# EasyEDA Pro project Iot-Whgm5开发板.eprj, board PCB1
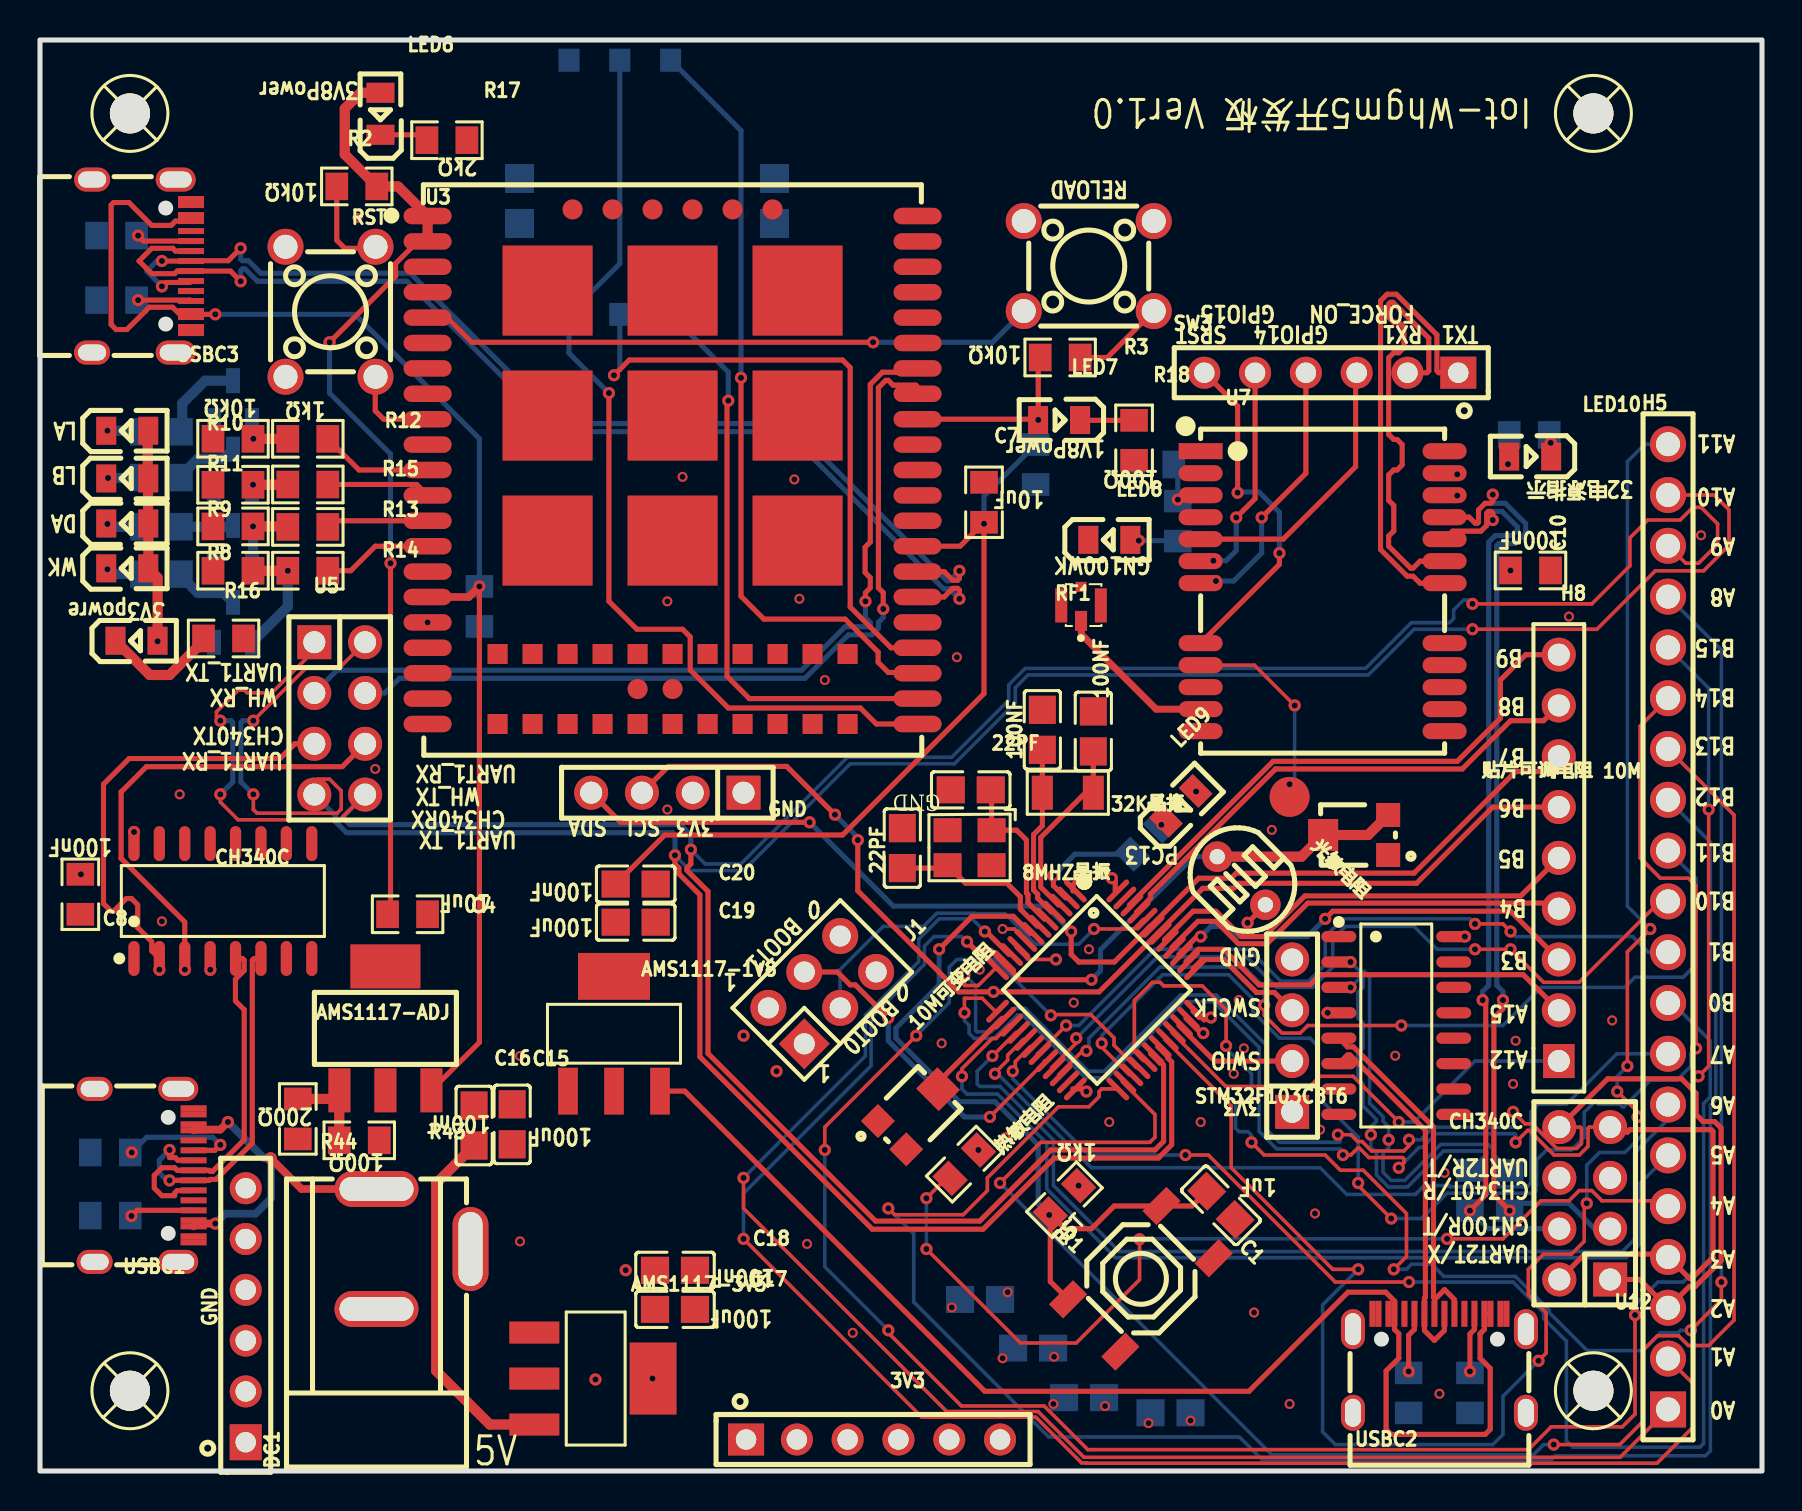
[diagram p2: board, top side]
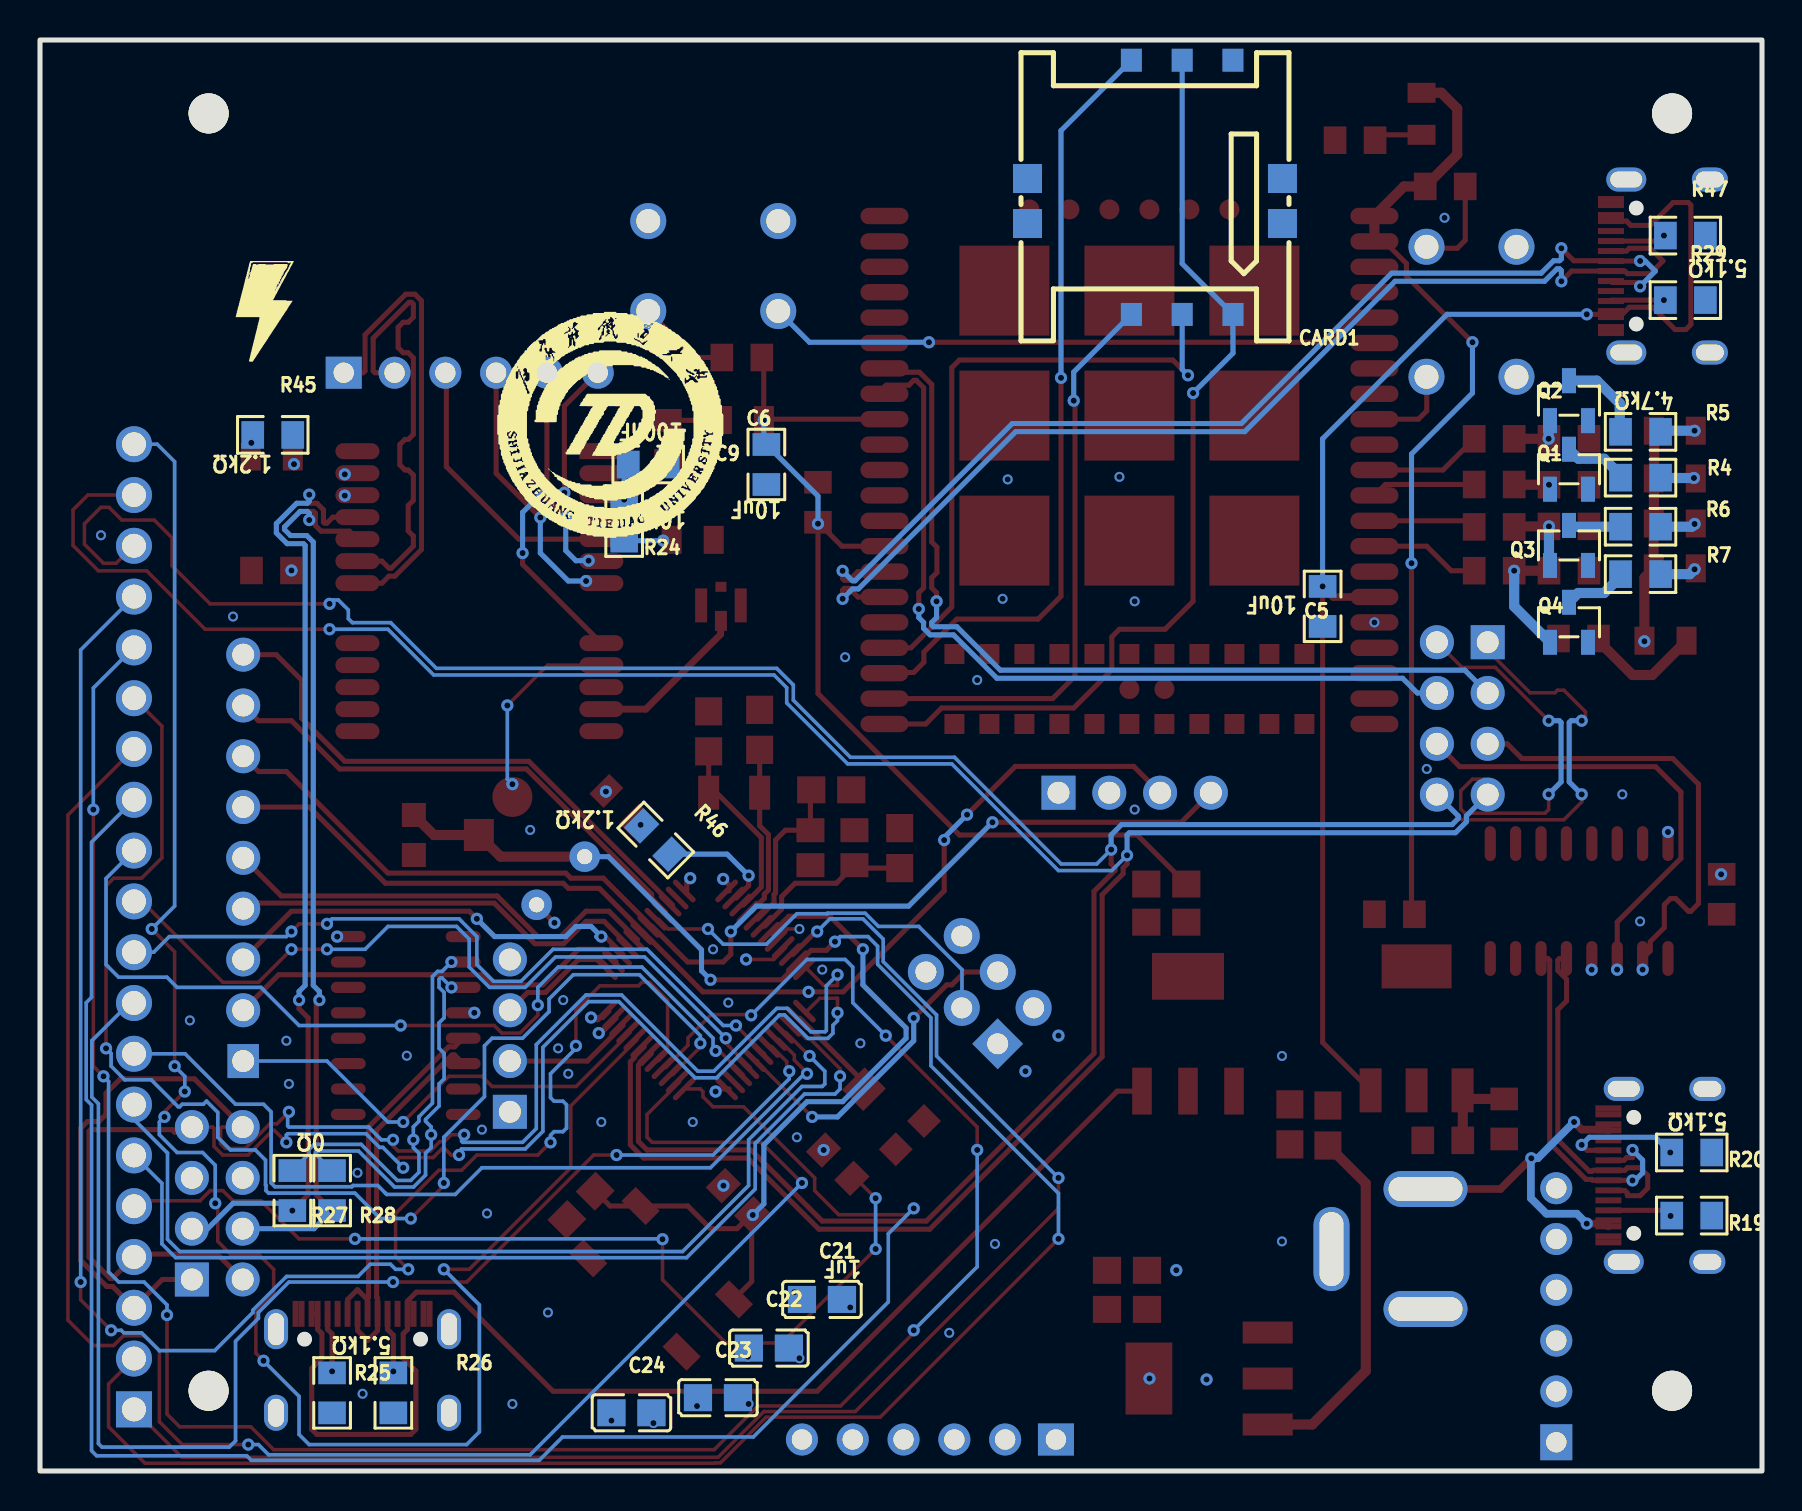
[diagram p3: board, bottom side, seen from below]

Outline 86.11 x 71.55 mm; copper layers: Top Layer, Inner1, Inner2, Bottom Layer. Coordinates in mm from the lower left corner of the outline.
Outline path: rectangle 0,71.55 86.11,0
Stack: Top Layer 0.035mm 外层铜厚1oz / Dielectric1 0.2104mm 7628 RC49% 8.6mil / Inner1 0.0152mm 内层铜厚 / Dielectric2 1.065mm 1.1mm H/HOZ 含铜 / Inner2 0.0152mm 内层铜厚 / Dielectric3 0.2104mm 7628 RC49% 8.6mil / Bottom Layer 0.035mm 外层铜厚1oz

## Design rules (mm)
net UART2_TX: DP10
net UART2_RX: DP10
net UART1_RX: DP8
net I2C1SCL: DP11
net I2C1SDA: DP11
net USBD-: DP3
net USBD+: DP3
net CH340TX: DP5
net CH340RX: DP5
net UART1_TX: DP8
net WH_RX: DP7
net WH_TX: DP7
net GN100_RXD: DP9
net GN100_TXD: DP9
net GN100RX1: DP4
net GN100TX1: DP4
net USBD-1: DP1
net USBD+1: DP1
net $1N7760: DP2
net $1N7771: DP2
net USBDM: DP6
net USBDP: DP6
template: 自定义配置
spacing copperThickness1oz (default): track to track 0, other pairs 0 to 0.3
spacing copperThickness2oz: track to track 0.203, other pairs 0.152 to 0.3
track width copperThickness1oz (default): min 0.127, default 0.254, max 2.54
track width copperThickness2oz: min 0.203, default 0.254, max 2.54
differential pair differentialPair (default): width min 0.127, default 0.254, max 2.54; gap min 0.152, default 0.152
via viaSize (default): diameter min 0.5, default 0.61, max 10; hole min 0.3, default 0.305, max 6.299
net GND uses copperRegion1

## Placement (name value [footprint] x y rotation side)
3V3  -  [HDR-TH_6P-P2.54-V-F]  41.66 1.57 0 top
8MHZ晶振  8MHz  [OSC-SMD_4P-L3.2-W2.5-BL]  46.48 31.17 180 top
10M可变电阻  10kΩ  [RES-ADJ-SMD_3P-L3.0-W3.8-P1.75-BR]  43.76 17.94 225 top
22PF  -  [C0805]  46.54 34.06 0 top
22PF#2  -  [C0805]  43.12 31.15 270 top
32K晶振  32.768kHz  [CRYSTAL-SMD_L3.2-W1.5-1]  51.4 33.91 0 top
100NF  -  [C0805]  50.12 37.06 90 top
100NF#2  -  [C0805]  52.67 36.98 270 top
AMS1117-1V8  AMS1117-1.8  [SOT-223-3_L6.7-W3.7-P2.30-LS7.0-BR]  28.7 21.86 270 top
AMS1117-3V3  AMS1117-3.3  [SOT-223-3_L6.5-W3.4-P2.30-LS7.0-BR]  27.69 4.62 180 top
AMS1117-ADJ  AMS1117-ADJ  [SOT-223_L6.7-W3.5-P2.30-BR]  17.27 22.13 270 top
C1  1uF  [C0805]  59.05 13.28 135 top
C4  10uF  [D0805]  18.38 27.84 180 top
C5  10uF  [D0805]  21.97 43.23 90 bottom
C6  10uF  [D0805]  49.78 50.33 270 bottom
C7  10uF  [D0805]  47.2 48.44 90 top
C8  100nF  [D0805]  2.02 28.84 90 top
C9  100nF  [D0805]  55.69 50.33 0 bottom
C10  100nF  [D0805]  74.53 45.03 180 top
C15  100uF  [C0805]  23.61 17.33 90 top
C16  100nF  [C0805]  21.71 17.27 90 top
C17  100uF  [C0805]  31.75 8.08 0 top
C18  100nF  [C0805]  31.75 10.04 0 top
C19  100uF  [C0805]  29.79 27.44 0 top
C20  100nF  [C0805]  29.79 29.35 0 top
C21  1uF  [C0805]  47.01 8.58 180 bottom
C22  1uF  [C0805]  49.66 6.15 180 bottom
C23  1uF  [C0805]  52.21 3.67 180 bottom
C24  1uF  [C0805]  56.53 2.91 180 bottom
CARD1  SIM-213  [SIM-SMD_SIM-213_C2836124]  30.35 64.19 0 bottom
CH340C  -  [SOP-16_L10.0-W3.9-P1.27-LS6.0-BL]  9.14 28.5 0 top
CH340C#2  -  [SOP-16_L10.0-W3.9-P1.27-LS6.0-BL]  67.82 22.28 270 top
DC1  DC-005-2.5A-2.0  [CONN-TH_DC-005-2.5A-2.0]  19.18 11.1 90 top
GND  -  [HDR-TH_4P-P2.54-V-F]  31.37 33.91 180 top
GND#2  -  [HDR-TH_6P-P2.54-V-F]  10.29 7.79 90 top
H1  PZ254V-11-04P  [HDR-TH_4P-P2.54-V-M]  62.61 21.77 90 top
H3  -  [HDR-TH_6P-P2.54-V-F]  64.57 54.91 180 top
H5  -  [HDR-TH_20P-P2.54-V-F]  81.41 27.21 90 top
H8  -  [HDR-TH_9P-P2.54-V-F-1]  75.95 30.66 90 top
J1  2.54-2*3P针  [HDR-TH_6P-P2.54-V-M-R2-C3-S2.54-1]  39.12 24.05 45 top
LED1  NCD0805R1  [LED0805-R-RD]  4.36 49.63 0 top
LED2  NCD0805R1  [LED0805-R-RD]  4.36 52.01 0 top
LED3  NCD0805R1  [LED0805-R-RD]  4.36 47.38 0 top
LED4  NCD0805R1  [LED0805-R-RD]  4.36 45.13 0 top
LED5  NCD0805R1  [LED0805-R-RD]  4.83 41.51 0 top
LED6  NCD0805R1  [LED0805-R-RD]  17.02 67.86 90 top
LED7  NCD0805R1  [LED0805-R-RD]  50.96 52.55 180 top
LED8  NCD0805R1  [LED0805-R-RD]  53.47 46.56 0 top
LED9  NCD0805R1  [LED0805-R-RD]  57.04 33.26 45 top
LED10  NCD0805R1  [LED0805-R-RD]  74.51 50.72 180 top
NOREF  -  [Pad_e6064]  62.48 33.71 0 top
Q1  SS8050  [SOT-23-3_L2.9-W1.3-P1.90-LS2.4-BR]  9.65 50.09 270 bottom
Q2  SS8050  [SOT-23-3_L2.9-W1.3-P1.90-LS2.4-BR]  9.65 53.52 270 bottom
Q3  SS8050  [SOT-23-3_L2.9-W1.3-P1.90-LS2.4-BR]  9.65 46.28 270 bottom
Q4  SS8050  [SOT-23-3_L2.9-W1.3-P1.90-LS2.4-BR]  9.65 42.44 270 bottom
R1  1kΩ  [R0805]  51.23 13.56 225 top
R2  10kΩ  [R0805]  15.84 64.23 180 top
R3  10kΩ  [R0805]  51.01 55.68 0 top
R4  4.7kΩ  [R0805]  6.07 49.67 180 bottom
R5  4.7kΩ  [R0805]  6.07 51.96 180 bottom
R6  4.7kΩ  [R0805]  6.07 47.22 180 bottom
R7  4.7kΩ  [R0805]  6.07 44.84 180 bottom
R8  10kΩ  [R0805]  9.65 45.02 0 top
R9  10kΩ  [R0805]  9.65 47.23 0 top
R10  10kΩ  [R0805]  9.65 51.61 0 top
R11  10kΩ  [R0805]  9.65 49.31 0 top
R12  1kΩ  [R0805]  13.39 51.61 0 top
R13  1kΩ  [R0805]  13.39 47.21 0 top
R14  1kΩ  [R0805]  13.39 45.02 0 top
R15  1kΩ  [R0805]  13.39 49.33 0 top
R16  1.2kΩ  [R0805]  9.18 41.63 180 top
R17  2kΩ  [R0805]  20.35 66.54 180 top
R18  100Ω  [R0805]  54.71 51.54 90 top
R19  5.1kΩ  [R0805]  3.51 12.77 0 bottom
R20  5.1kΩ  [R0805]  3.51 15.93 180 bottom
R24  10kΩ  [R0805]  56.9 47.5 270 bottom
R25  5.1kΩ  [R0805]  71.5 3.91 90 bottom
R26  5.1kΩ  [R0805]  68.44 3.91 270 bottom
R27  0Ω  [R0805]  73.49 14.02 90 bottom
R28  0Ω  [R0805]  71.5 14.02 270 bottom
R29  5.1kΩ  [R0805]  3.83 58.55 0 bottom
R43  100Ω  [R0805]  15.96 16.53 0 top
R44  200Ω  [R0805]  12.89 17.6 90 top
R45  1.2kΩ  [R0805]  74.47 51.81 180 bottom
R46  1.2kΩ  [R0805]  55.31 31.55 225 bottom
R47  5.1kΩ  [R0805]  3.83 61.77 180 bottom
RF1  IPEX-4  [IPEX-SMD_4P-L1.8-W1.7-LS2.0]  52.06 43.36 0 top
RST  -  [SW-SMD_4P-L5.1-W5.1-P3.70-LS6.5-TL-2]  55.05 9.61 225 top
RST#2  -  [SW-TH_4P-L6.0-W6.0-P4.50-LS6.5]  14.53 57.96 270 top
STM32F103C8T6  STM32F103C8T6  [LQFP-48_L7.0-W7.0-P0.50-LS9.0-BL]  52.83 24.05 225 top
SW3  TS665CJ  [SW-TH_4P-L6.0-W6.0-P4.50-LS6.5]  52.44 60.25 180 top
TP8  -  [M2螺丝]  4.5 67.88 0 top
TP9  -  [M2螺丝]  4.5 4.01 0 top
TP10  -  [M2螺丝]  77.68 4.01 0 top
TP11  -  [M2螺丝]  77.68 67.88 0 top
U3  WH-GM5  [LCC-LGA-81_L28.1-W24.5-P1.27-TL]  31.63 50.22 0 top
U5  PZ2.54-2*4  [HDR-TH_8P-P2.54-V-M-R2-C4-S2.54]  14.99 37.63 270 top
U7  WH-GN100  [GPSM-SMD_WH-GN100]  64.13 43.99 0 top
U12  PZ2.54-2*4  [HDR-TH_8P-P2.54-V-M-R2-C4-S2.54]  77.24 13.39 90 top
USBC1  TYPE-C-31-M-12  [USB-C_SMD-TYPE-C-31-M-12]  5.21 14.78 270 top
USBC2  TYPE-C-31-M-12  [USB-C_SMD-TYPE-C-31-M-12]  69.98 5.38 0 top
USBC3  TYPE-C-31-M-12  [USB-C_SMD-TYPE-C-31-M-12]  5.08 60.25 270 top
光敏电阻  光敏电阻  [RES-TH_L5.1-W4.3-P3.40-D0.5]  60.07 29.51 225 top
热敏电阻  10k 热敏电阻  [R0805]  46.22 15.34 225 top
贴片可调电阻 10M  10kΩ  [RES-ADJ-SMD_3P-L3.0-W3.8-P1.75-BR]  65.79 31.8 0 top

## Footprints (pads in the part's own frame, mm; a bottom-side part is the same pattern mirrored in y, then rotated)
C0805
  rect 1.41x1.35 smd: 1(-1,0) 2(1,0)
CONN-TH_DC-005-2.5A-2.0
  oval 1.8x4.2 hole 1.2x3.7: 1(2.999,2.35) 2(-2.999,2.35)
  oval 4.2x1.8 hole 3.7x1.2: 3(0,-2.35)
CRYSTAL-SMD_L3.2-W1.5-1
  rect 1.05x1.7 smd: 1(-1.275,0) 2(1.275,0)
D0805
  rect 1.133x1.377 smd: 1(-1,0) 2(1,0)
GPSM-SMD_WH-GN100
  rect 2.2x0.8 smd: 1(-6.1,7)
  oval 2.2x0.8 smd: 2(-6.1,5.9) 3(-6.1,4.8) 4(-6.1,3.7) 5(-6.1,2.6) 6(-6.1,1.5) 7(-6.1,0.4) 8(-6.1,-2.6) 9(-6.1,-3.7) 10(-6.1,-4.8) 11(-6.1,-5.9) 12(-6.1,-7) 13(6.1,-7) 14(6.1,-5.9) 15(6.1,-4.8) 16(6.1,-3.7) 17(6.1,-2.6) 18(6.1,0.4) 19(6.1,1.5) 20(6.1,2.6) 21(6.1,3.7) 22(6.1,4.8) 23(6.1,5.9) 24(6.1,7)
HDR-TH_4P-P2.54-V-F
  rect 1.7x1.7 hole 1.1: 1(-3.81,0)
  round 1.7 hole 1.1: 2(-1.27,0) 3(1.27,0) 4(3.81,0)
HDR-TH_4P-P2.54-V-M
  rect 1.7x1.7 hole 1.1: 1(-3.81,0)
  round 1.7 hole 1.1: 2(-1.27,0) 3(1.27,0) 4(3.81,0)
HDR-TH_6P-P2.54-V-F
  rect 1.8x1.6 hole 1.02: 1(-6.35,0)
  round 1.6 hole 1.02: 2(-3.81,0) 3(-1.27,0) 4(1.27,0) 5(3.81,0) 6(6.35,0)
HDR-TH_6P-P2.54-V-M-R2-C3-S2.54-1
  rect 1.8x1.8 hole 1.05: 1(-2.54,-1.27)
  round 1.8 hole 1.05: 2(-2.54,1.27) 3(0,-1.27) 4(0,1.27) 5(2.54,-1.27) 6(2.54,1.27)
HDR-TH_8P-P2.54-V-M-R2-C4-S2.54
  rect 1.7x1.7 hole 1.1: 1(-3.81,-1.27)
  round 1.7 hole 1.1: 2(-3.81,1.27) 3(-1.27,-1.27) 4(-1.27,1.27) 5(1.27,-1.27) 6(1.27,1.27) 7(3.81,-1.27) 8(3.81,1.27)
HDR-TH_9P-P2.54-V-F-1
  rect 1.7x1.575 hole 1.1: 1(-10.16,0)
  round 1.7 hole 1.1: 2(-7.62,0) 3(-5.08,0) 4(-2.54,0) 5(0,0) 6(2.54,0) 7(5.08,0) 8(7.62,0) 9(10.16,0)
HDR-TH_20P-P2.54-V-F
  rect 1.8x1.8 hole 1.2: 1(-24.13,0)
  round 1.8 hole 1.2: 2(-21.59,0) 3(-19.05,0) 4(-16.51,0) 5(-13.97,0) 6(-11.43,0) 7(-8.89,0) 8(-6.35,0) 9(-3.81,0) 10(-1.27,0) 11(1.27,0) 12(3.81,0) 13(6.35,0) 14(8.89,0) 15(11.43,0) 16(13.97,0) 17(16.51,0) 18(19.05,0) 19(21.59,0) 20(24.13,0)
IPEX-SMD_4P-L1.8-W1.7-LS2.0
  rect 0.6x1 smd: 1(0.001,-0.852)
  rect 0.6x1.7 smd: 2(0.99,-0.077) 4(-0.99,-0.077)
  rect 0.55x0.5 smd: 3(0.001,0.852)
LCC-LGA-81_L28.1-W24.5-P1.27-TL
  oval 2.4x0.82 smd: 1(-12.25,12.535) 2(-12.25,11.265) 3(-12.25,9.995) 4(-12.25,8.725) 5(-12.25,7.455) 6(-12.25,6.185) 7(-12.25,4.915) 8(-12.25,3.645) 9(-12.25,2.375) 10(-12.25,1.105) 11(-12.25,-0.165) 12(-12.25,-1.435) 13(-12.25,-2.705) 14(-12.25,-3.975) 15(-12.25,-5.245) 16(-12.25,-6.515) 17(-12.25,-7.785) 18(-12.25,-9.055) 19(-12.25,-10.325) 20(-12.25,-11.595) 21(-12.25,-12.865) 22(12.25,-12.865) 23(12.25,-11.595) 24(12.25,-10.325) 25(12.25,-9.055) 26(12.25,-7.785) 27(12.25,-6.515) 28(12.25,-5.245) 29(12.25,-3.975) 30(12.25,-2.705) 31(12.25,-1.435) 32(12.25,-0.165) 33(12.25,1.105) 34(12.25,2.375) 35(12.25,3.645) 36(12.25,4.915) 37(12.25,6.185) 38(12.25,7.455) 39(12.25,8.725) 40(12.25,9.995) 41(12.25,11.265) 42(12.25,12.535)
  rect 1x1 smd: 43(-8.75,-12.865) 44(-7,-12.865) 45(-5.25,-12.865) 46(-3.5,-12.865) 47(-1.75,-12.865) 48(0,-12.865) 49(1.75,-12.865) 50(3.5,-12.865) 51(5.25,-12.865) 52(7,-12.865) 53(8.75,-12.865) 54(-8.75,-9.365) 66(-7,-9.365) 67(-5.25,-9.365) 68(-3.5,-9.365) 69(-1.75,-9.365) 70(0,-9.365) 71(1.75,-9.365) 72(3.5,-9.365) 73(5.25,-9.365) 74(7,-9.365) 75(8.75,-9.365)
  rect 4.5x4.5 smd: 55(-6.25,8.805) 56(0,8.805) 57(6.25,8.805) 58(6.25,2.555) 59(0,2.555) 60(-6.25,2.555) 61(-6.25,-3.695) 62(0,-3.695) 63(6.25,-3.695)
  round 1 smd: 64(-1.75,-11.115) 65(0,-11.115) 76(-5,12.865) 77(-3,12.865) 78(-1,12.865) 79(1,12.865) 80(3,12.865) 81(5,12.865)
LED0805-R-RD
  rect 1x1.399 smd: 1(1.05,0) 2(-1.05,0)
LQFP-48_L7.0-W7.0-P0.50-LS9.0-BL
  oval 0.27x1.5 smd: 1(-2.75,-4.25) 2(-2.25,-4.25) 3(-1.75,-4.25) 4(-1.25,-4.25) 5(-0.75,-4.25) 6(-0.25,-4.25) 7(0.25,-4.25) 8(0.75,-4.25) 9(1.25,-4.25) 10(1.75,-4.25) 11(2.25,-4.25) 12(2.75,-4.25) 25(2.75,4.25) 26(2.25,4.25) 27(1.75,4.25) 28(1.25,4.25) 29(0.75,4.25) 30(0.25,4.25) 31(-0.25,4.25) 32(-0.75,4.25) 33(-1.25,4.25) 34(-1.75,4.25) 35(-2.25,4.25) 36(-2.75,4.25)
  oval 1.5x0.27 smd: 13(4.25,-2.75) 14(4.25,-2.25) 15(4.25,-1.75) 16(4.25,-1.25) 17(4.25,-0.75) 18(4.25,-0.25) 19(4.25,0.25) 20(4.25,0.75) 21(4.25,1.25) 22(4.25,1.75) 23(4.25,2.25) 24(4.25,2.75) 37(-4.25,2.75) 38(-4.25,2.25) 39(-4.25,1.75) 40(-4.25,1.25) 41(-4.25,0.75) 42(-4.25,0.25) 43(-4.25,-0.25) 44(-4.25,-0.75) 45(-4.25,-1.25) 46(-4.25,-1.75) 47(-4.25,-2.25) 48(-4.25,-2.75)
M2螺丝
  round 2 hole 2: 1(0,0)
OSC-SMD_4P-L3.2-W2.5-BL
  rect 1.4x1.2 smd: 1(-1.1,-0.875) 2(1.1,-0.875) 3(1.1,0.875) 4(-1.1,0.875)
Pad_e6064
  round 2 smd: 1(0,0)
R0805
  rect 1.133x1.377 smd: 1(-1,0) 2(1,0)
RES-ADJ-SMD_3P-L3.0-W3.8-P1.75-BR
  rect 1.2x1.2 smd: 1(1.625,-1) 3(1.625,1)
  rect 1.5x1.6 smd: 2(-1.625,0)
RES-TH_L5.1-W4.3-P3.40-D0.5
  round 1.524 hole 0.762: 1(0,1.7) 2(0,-1.7)
SIM-SMD_SIM-213_C2836124
  rect 1.05x1.15 smd: 1(-3.9,6.355) 2(-1.36,6.355) 3(1.18,6.355) 5(-3.9,-6.355) 6(-1.36,-6.355) 7(1.18,-6.355)
  rect 1.45x1.45 smd: 8(-6.375,-0.44) 9(6.375,-0.44) 10(6.375,1.81) 11(-6.375,1.81)
SOP-16_L10.0-W3.9-P1.27-LS6.0-BL
  oval 0.56x1.745 smd: 1(-4.445,-2.873) 2(-3.175,-2.873) 3(-1.905,-2.873) 4(-0.635,-2.873) 5(0.635,-2.873) 6(1.905,-2.873) 7(3.175,-2.873) 8(4.445,-2.873) 9(4.445,2.873) 10(3.175,2.873) 11(1.905,2.873) 12(0.635,2.873) 13(-0.635,2.873) 14(-1.905,2.873) 15(-3.175,2.873) 16(-4.445,2.873)
SOT-23-3_L2.9-W1.3-P1.90-LS2.4-BR
  rect 1.25x0.7 smd: 1(1,-0.95) 2(1,0.95) 3(-1,0)
SOT-223-3_L6.5-W3.4-P2.30-LS7.0-BR
  rect 2.5x1.1 smd: 1(2.97,-2.3) 2(2.97,0) 3(2.97,2.3)
  rect 2.34x3.6 smd: 4(-2.97,0)
SOT-223-3_L6.7-W3.7-P2.30-LS7.0-BR
  rect 2.34x0.98 smd: 1(2.87,-2.3) 2(2.87,0) 3(2.87,2.3)
  rect 2.34x3.6 smd: 4(-2.87,0)
SOT-223_L6.7-W3.5-P2.30-BR
  rect 2.2x1.1 smd: 1(3.099,-2.3) 2(3.099,0) 3(3.099,2.3)
  rect 2.2x3.5 smd: 4(-3.099,0)
SW-SMD_4P-L5.1-W5.1-P3.70-LS6.5-TL-2
  rect 1.7x1 smd: 1(-3.3,1.85) 2(3.3,1.85) 3(-3.3,-1.85) 4(3.3,-1.85)
SW-TH_4P-L6.0-W6.0-P4.50-LS6.5
  round 1.8 hole 1.2: 1(-3.25,2.25) 2(3.25,2.25) 3(-3.25,-2.25) 4(3.25,-2.25)
USB-C_SMD-TYPE-C-31-M-12
  oval 1.2x2 hole 0.8x1.6: 0(-4.325,1.706) 1(4.325,1.706)
  oval 1.2x1.8 hole 0.8x1.4: 2(4.325,-2.474) 3(-4.325,-2.474)
  rect 0.3x1.3 smd: A1(-3.35,2.474) A4(-2.55,2.474) A5(-1.25,2.474) A6(-0.25,2.474) A7(0.25,2.474) A8(1.25,2.474) A9(2.55,2.474) A12(3.35,2.474) B1(3.05,2.474) B4(2.25,2.474) B5(1.75,2.474) B6(0.75,2.474) B7(-0.75,2.474) B8(-1.75,2.474) B9(-2.25,2.474) B12(-3.05,2.474)

## Nets
1V8: AMS1117-1V8.2 AMS1117-1V8.4 C6.1 C7.1 C19.1 C20.1 LED7.1 R3.1 U3.29 U3.34
3V3: 3V3.1 3V3.2 3V3.3 3V3.4 3V3.5 3V3.6 AMS1117-3V3.2 AMS1117-3V3.4 C8.2 C10.2 C17.1 C18.1 C21.2 C22.2 C23.2 C24.2 CH340C.4 CH340C.16 CH340C#2.4 CH340C#2.16 GND.2 H1.1 J1.1 J1.2 LED1.1 LED2.1 LED3.1 LED4.1 LED5.1 LED9.1 LED10.1 R1.1 STM32F103C8T6.1 STM32F103C8T6.9 STM32F103C8T6.24 STM32F103C8T6.36 STM32F103C8T6.48 U7.22 U7.23 光敏电阻.1 热敏电阻.1
3V8: AMS1117-ADJ.2 AMS1117-ADJ.4 C4.2 LED6.1 R2.1 R43.2 U3.1 U3.2
5V0: AMS1117-1V8.3 AMS1117-3V3.3 AMS1117-ADJ.3 C5.2 C15.1 C16.1 DC1.1 U3.16 USBC1.A4 USBC1.A9 USBC1.B4 USBC1.B9 USBC2.A4 USBC2.A9 USBC2.B4 USBC2.B9 USBC3.A4 USBC3.A9 USBC3.B4 USBC3.B9
GND: 8MHZ晶振.2 8MHZ晶振.4 10M可变电阻.1 22PF.1 22PF#2.1 100NF.2 100NF#2.1 AMS1117-1V8.1 AMS1117-3V3.1 C1.1 C4.1 C5.1 C6.2 C7.2 C8.1 C9.1 C10.1 C15.2 C16.2 C17.2 C18.2 C19.2 C20.2 C21.1 C22.1 C23.1 C24.1 CARD1.5 CARD1.8 CARD1.9 CARD1.10 CARD1.11 CH340C.1 CH340C#2.1 DC1.2 DC1.3 GND.1 GND#2.1 GND#2.2 GND#2.3 GND#2.4 GND#2.5 GND#2.6 H1.4 J1.5 J1.6 LED8.2 Q1.2 Q2.2 Q3.2 Q4.2 R8.1 R9.1 R10.1 R11.1 R16.1 R17.1 R18.1 R19.1 R20.2 R25.1 R26.2 R29.1 R44.1 R45.2 R47.2 RF1.2 RF1.3 RF1.4 RST.1 RST.2 RST#2.3 RST#2.4 STM32F103C8T6.8 STM32F103C8T6.23 STM32F103C8T6.35 STM32F103C8T6.47 SW3.3 SW3.4 TP8.1 TP9.1 TP10.1 TP11.1 U3.3 U3.4 U3.17 U3.39 U3.40 U3.42 U7.10 U7.12 U7.13 U7.24 USBC1.0 USBC1.1 USBC1.2 USBC1.3 USBC1.A1 USBC1.A12 USBC1.B1 USBC1.B12 USBC2.0 USBC2.1 USBC2.2 USBC2.3 USBC2.A1 USBC2.A12 USBC2.B1 USBC2.B12 USBC3.0 USBC3.1 USBC3.2 USBC3.3 USBC3.A1 USBC3.A12 USBC3.B1 USBC3.B12 贴片可调电阻 10M.1
VCCRF: NOREF.1 U7.9
ADC_IN1: H5.2 STM32F103C8T6.11 光敏电阻.2 贴片可调电阻 10M.2 贴片可调电阻 10M.3
ADC_IN4: 10M可变电阻.2 10M可变电阻.3 H5.5 STM32F103C8T6.14 热敏电阻.2
BOOT0: J1.3 STM32F103C8T6.44
BOOT1: J1.4 STM32F103C8T6.20
CH340RX: CH340C.3 U5.6
CH340RX1: CH340C#2.3 U12.6
CH340TX: CH340C.2 U5.5
CH340TX1: CH340C#2.2 U12.5
DATA: R13.2 U3.13
DRX: U3.32
DTX: U3.33
FORCE_ON: H3.3 U7.5
GN100_RXD: R27.1 U7.21 U12.3
GN100_TXD: R28.2 U7.20 U12.4
GN100RST: H3.6 U7.8
GN100RX1: H3.2 U7.19
GN100TX1: H3.1 U7.18
GPIO14: H3.4 U7.7
GPIO15: H3.5 U7.6
GPRS: U3.10
I2C1SCL: GND.3 H8.6 STM32F103C8T6.42
I2C1SDA: GND.4 H8.7 STM32F103C8T6.43
IPPS: C9.2 R24.1 U7.3
KEYIN: U3.31
LINKA: R12.2 U3.11
LINKB: R15.2 U3.12
OSC32_IN: 32K晶振.2 100NF#2.2 STM32F103C8T6.3
OSC32_OUT: 32K晶振.1 100NF.1 STM32F103C8T6.4
OSC_IN: 8MHZ晶振.1 22PF.2 STM32F103C8T6.5
OSC_OUT: 8MHZ晶振.3 22PF#2.2 STM32F103C8T6.6
PA0: H5.1 STM32F103C8T6.10
PA5: H5.6 STM32F103C8T6.15
PA6: H5.7 STM32F103C8T6.16
PA7: H5.8 STM32F103C8T6.17
PA8: H5.17 STM32F103C8T6.29
PA11: H5.20 STM32F103C8T6.32
PA12: H8.1 STM32F103C8T6.33
PA15: H8.2 STM32F103C8T6.38
PB0: H5.9 STM32F103C8T6.18
PB1: H5.10 STM32F103C8T6.19
PB3: H8.3 STM32F103C8T6.39
PB4: H8.4 STM32F103C8T6.40
PB5: H8.5 STM32F103C8T6.41
PB8: H8.8 STM32F103C8T6.45
PB9: H8.9 STM32F103C8T6.46
PB10: H5.11 STM32F103C8T6.21
PB11: H5.12 STM32F103C8T6.22
PB12: H5.13 STM32F103C8T6.25
PB13: H5.14 STM32F103C8T6.26
PB14: H5.15 STM32F103C8T6.27
PB15: H5.16 STM32F103C8T6.28
PC13: R46.2 STM32F103C8T6.2
RELOAD: SW3.2 U3.5
RF_IN: RF1.1 U7.11
RST: C1.2 R1.2 RST.3 RST.4 STM32F103C8T6.7
SCLK: CARD1.3 U3.23
SDAT: CARD1.7 U3.24
SRST: CARD1.2 U3.25
SWCLK: H1.3 STM32F103C8T6.37
SWIO: H1.2 STM32F103C8T6.34
UART1_RX: H5.19 STM32F103C8T6.31 U5.2 U5.7
UART1_TX: H5.18 STM32F103C8T6.30 U5.1 U5.8
UART2_RX: H5.4 STM32F103C8T6.13 U12.2 U12.7
UART2_TX: H5.3 STM32F103C8T6.12 U12.1 U12.8
USBD+: CH340C.5 USBC1.A6 USBC1.B6
USBD+1: CH340C#2.5 USBC2.A6 USBC2.B6
USBD-: CH340C.6 USBC1.A7 USBC1.B7
USBD-1: CH340C#2.6 USBC2.A7 USBC2.B7
USBDM: U3.27 USBC3.A7 USBC3.B7
USBDP: U3.28 USBC3.A6 USBC3.B6
VSIM: CARD1.1 CARD1.6 U3.22
WH_RX: U3.36 U5.3
WH_TX: U3.35 U5.4
WORK: R14.2 U3.14
WRST: RST#2.2 U3.9
$1N2451: R3.2 SW3.1
$1N2460: R2.2 RST#2.1
$1N2726: Q1.3 R4.1
$1N2765: Q2.3 R5.1
$1N2804: Q3.3 R6.1
$1N2899: Q4.3 R7.1
$1N2935: LED1.2 R4.2
$1N2943: LED2.2 R5.2
$1N2948: LED4.2 R7.2
$1N2949: LED3.2 R6.2
$1N3568: Q2.1 R10.2 R12.1
$1N3650: Q4.1 R8.2 R14.1
$1N3655: Q3.1 R9.2 R13.1
$1N3697: Q1.1 R11.2 R15.1
$1N3835: LED5.2 R16.2
$1N3918: LED6.2 R17.2
$1N4097: LED7.2 R18.2
$1N4826: R19.2 USBC1.B5
$1N4873: R20.1 USBC1.A5
$1N6955: LED8.1 R24.2
$1N7251: R25.2 USBC2.B5
$1N7254: R26.1 USBC2.A5
$1N7760: R27.2
$1N7771: R28.1
$2N1856: R29.2 USBC3.B5
$2N1859: R47.1 USBC3.A5
$2N2137: AMS1117-ADJ.1 R43.1 R44.2
$2N3608: LED9.2 R46.1
$2N3829: LED10.2 R45.1

Pads without a net: CH340C 7 8 9 10 11 12 13 14 15; CH340C#2 7 8 9 10 11 12 13 14 15; U3 6 7 8 15 18 19 20 21 26 30 37 38 41 43 44 45 46 47 48 49 50 51 52 53 54 55 56 57 58 59 60 61 62 63 64 65 66 67 68 69 70 71 72 73 74 75 76 77 78 79 80 81; U7 1 2 4 14 15 16 17; USBC1 A8 B8; USBC2 A8 B8; USBC3 A8 B8

## Via types
v1: diameter 0.61, hole 0.305, Top Layer to Bottom Layer, 167 vias
v2: diameter 0.5, hole 0.299, Top Layer to Bottom Layer, 48 vias
v3: diameter 0.5, hole 0.3, Top Layer to Bottom Layer, 1 via
